# EasyEDA Pro project BLDCv5.eprj, schematic Schematic5
Board Name: Board3; Create Date: 2025-03-22; Page Name: P1; Project Name: BLDCv5; Schematic Name: Schematic5; Update Date: 2025-03-22; Company: EasyEDA.com; Drawn: EasyEDA; Page Size: A4; Part Number: JLCPCB-002; Reviewed: EasyEDA; Version: V0.1
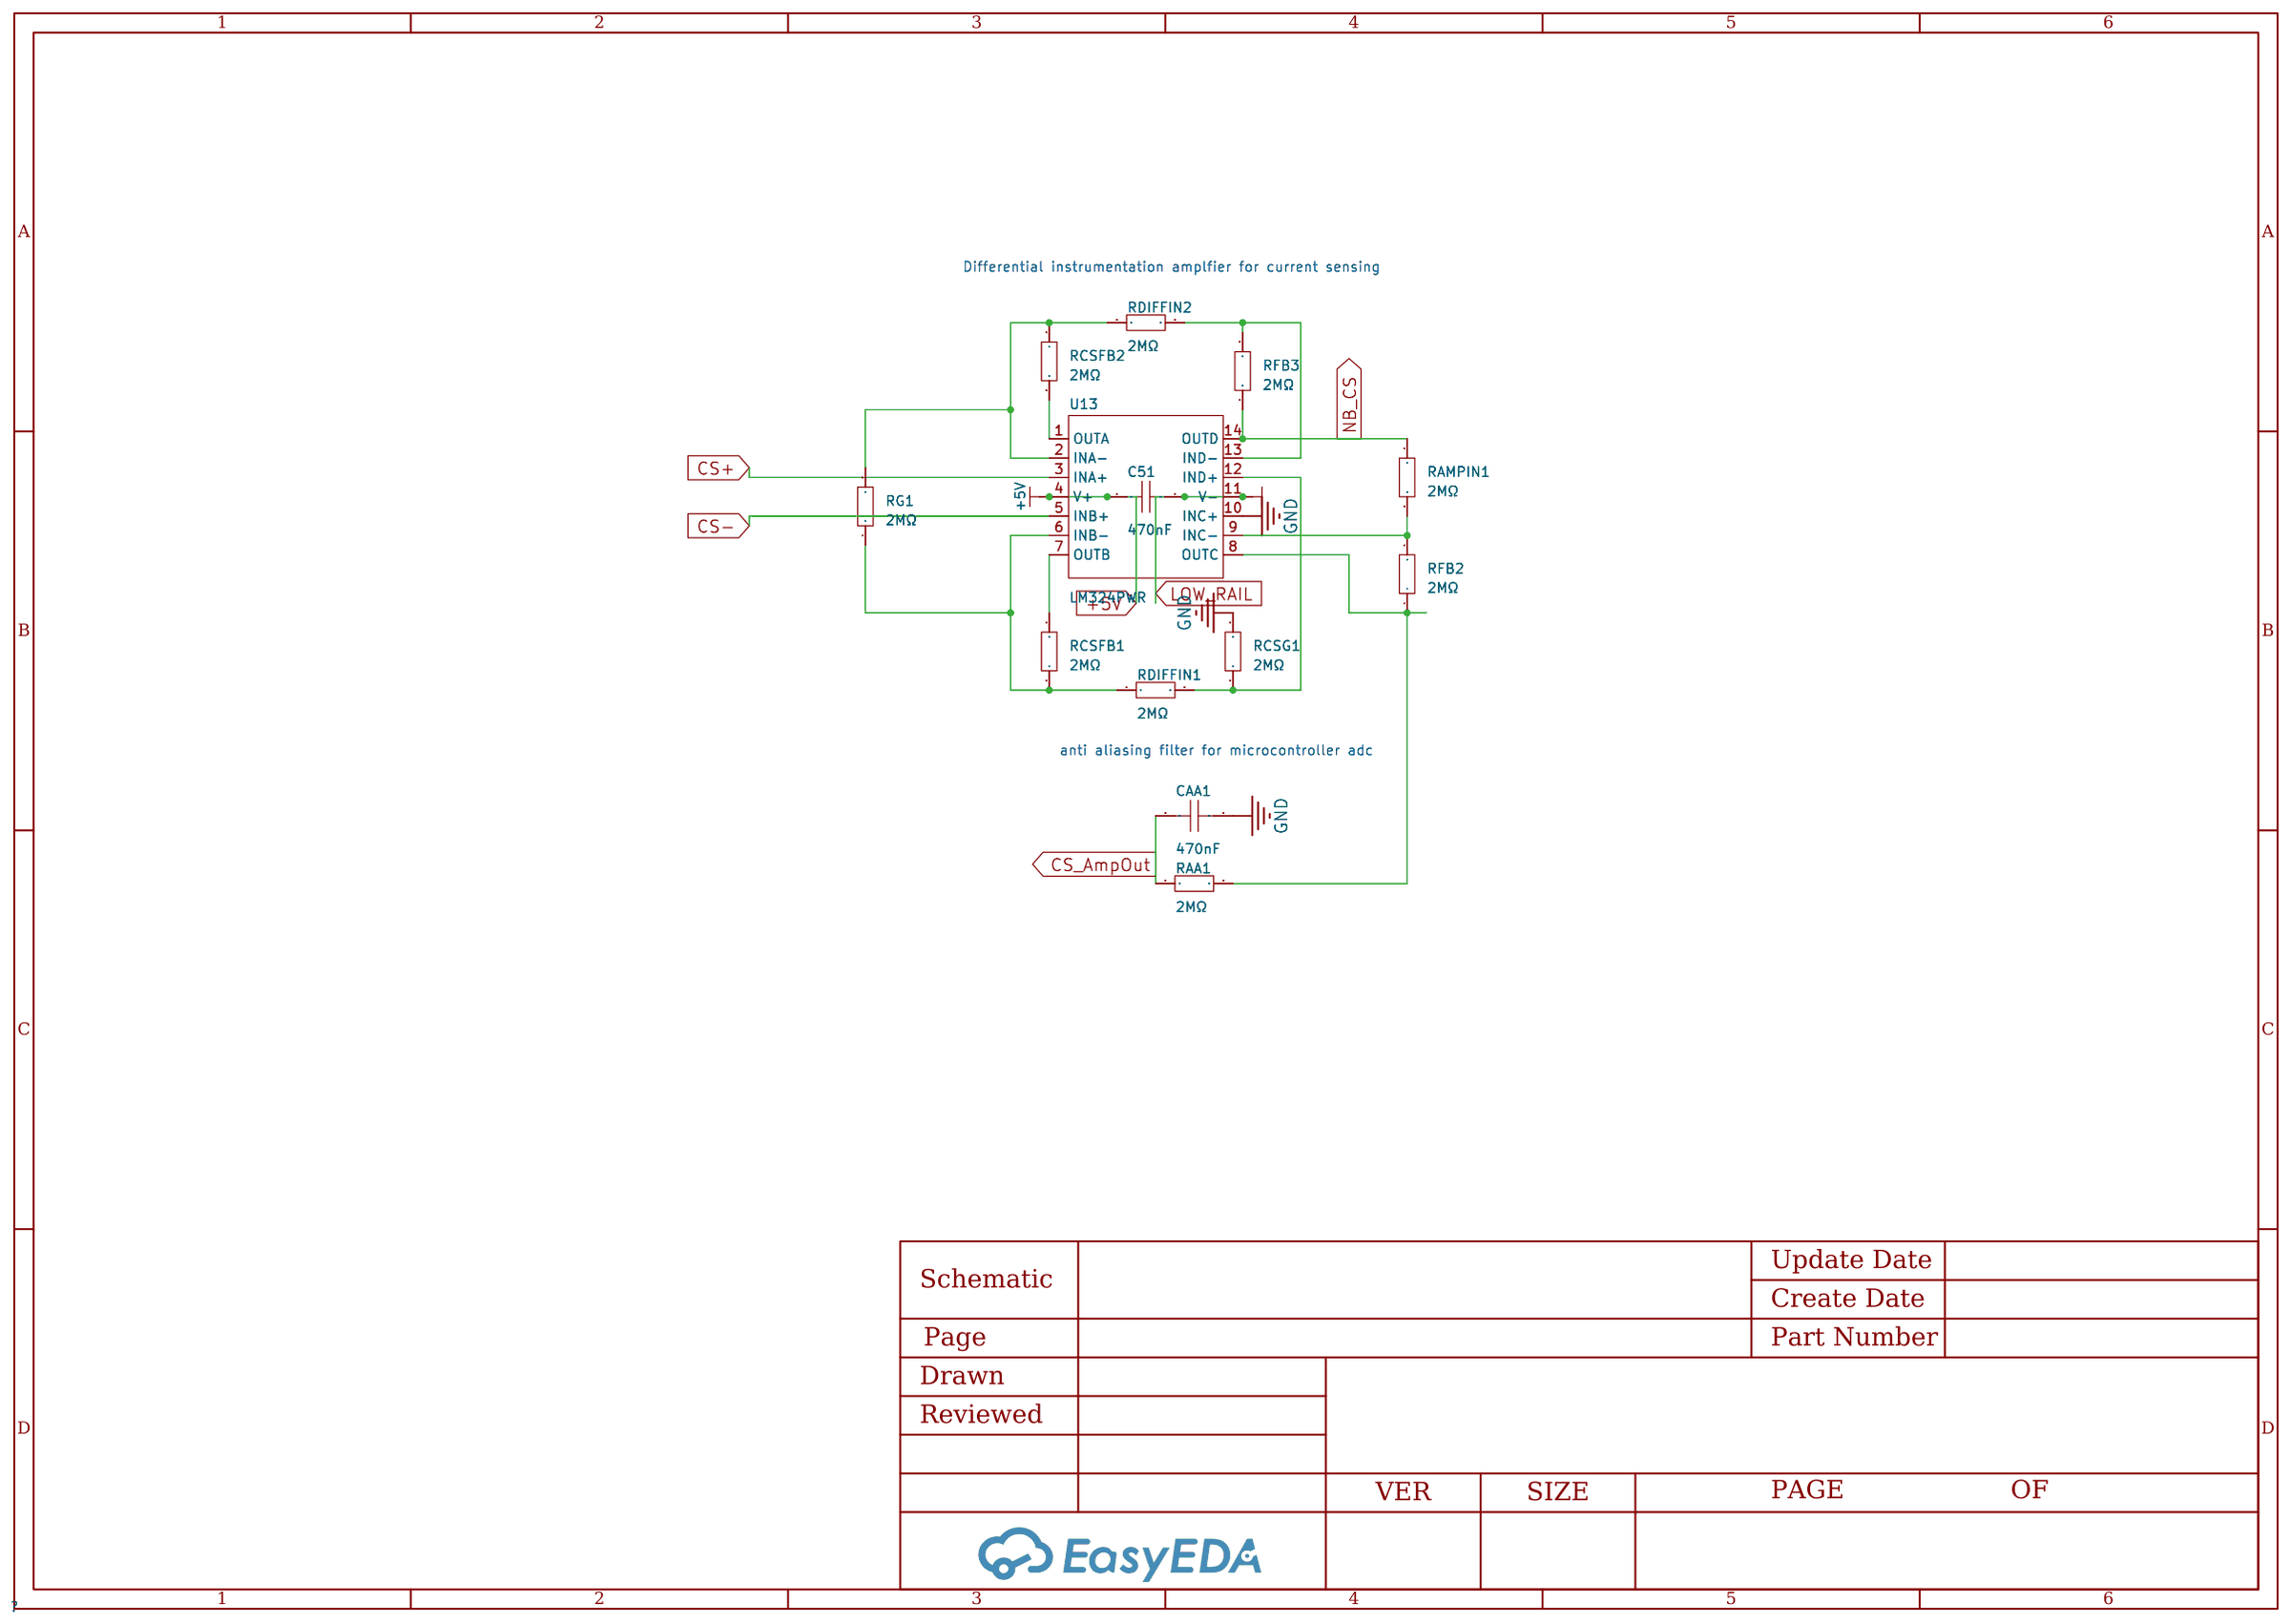
[diagram p6: schematic sheet]

## Parts
C51  470nF  [CAP-TH_L7.2-W2.5-P5.00-D0.5]
CAA1  470nF  [CAP-TH_L7.2-W2.5-P5.00-D0.5]
RAA1  2MΩ  [R0805]
RAMPIN1  2MΩ  [R0805]
RCSFB1  2MΩ  [R0805]
RCSFB2  2MΩ  [R0805]
RCSG1  2MΩ  [R0805]
RDIFFIN1  2MΩ  [R0805]
RDIFFIN2  2MΩ  [R0805]
RFB2  2MΩ  [R0805]
RFB3  2MΩ  [R0805]
RG1  2MΩ  [R0805]
U13  LM324PWR  [TSSOP-14_L5.0-W4.4-P0.65-LS6.4-BL]

## Library data of the parts
C51 CAA1 = C241J474J20C000: Capacitance:470nF Tolerance:±5% Tolerance:±5% Voltage Rated: Dielectric Material:Metallized Polyester Film Capacitor Operating Temperature:-55℃~+125℃ Operating Temperature:-55℃~+125℃; LCSC Part Name: 470nF ±5% 63V; Supplier Part: C5121927; Manufacturer: faratronic(厦门法拉); Supplier Footprint: 插件,P=5mm; JLCPCB Part Class: Extended Part; Datasheet: https://atta.szlcsc.com/upload/public/pdf/source/20220309/53E9D6585E584592026F1B9FCED89B93.pdf; Supplier: LCSC; Tolerance: ±5%; Dielectric Material: Metallized Polyester Film Capacitor; Operating Temperature: -55℃~+125℃
RAA1 RAMPIN1 RCSFB1 RCSFB2 RCSG1 RDIFFIN1 RDIFFIN2 RFB2 RFB3 RG1 = SCR0805J2M: Type:Thick Film Resistors Resistance:2MΩ Tolerance:±5% Tolerance:±5% Power(Watts): Overload Voltage (Max): Operating Temperature Range:-55℃~+155℃ Operating Temperature Range:-55℃~+155℃; LCSC Part Name: 厚膜电阻 2MΩ ±5% 125mW; Supplier Part: C3017921; Manufacturer: VO(翔胜); Supplier Footprint: 0805; JLCPCB Part Class: Extended Part; Datasheet: https://atta.szlcsc.com/upload/public/pdf/source/20220513/247AF9639BA21CF93567DC289CCC6A22.pdf; Supplier: LCSC; Type: Thick Film Resistors; Tolerance: ±5%; Operating Temperature Range: -55℃~+155℃
U13 = LM324PWR: Supplier Part: C7942; Manufacturer: TI(德州仪器); Supplier Footprint: TSSOP-14; JLCPCB Part Class: Extended Part; Datasheet: http://www.ti.com/cn/lit/gpn/lm324; Supplier: LCSC; Number of Circuits: Quad; Gain Bandwidth Product(GBP): 1.2MHz; Current - Input Bias(Ib): 20nA; Slew Rate(SR): 0.5V/us; Output Current: 30mA; Supply Current: 700uA; Operating Temperature: 0℃~+70℃

## Nets
+5V: C51.2 U13.4(V+)
GND: CAA1.1 RCSG1.2 U13.10(INC+)
CS+: U13.3(INA+)
CS-: U13.5(INB+)
CS_AmpOut: CAA1.2 RAA1.1
LOW_RAIL: C51.1 U13.11(V-)
NB_CS: RAMPIN1.1 RFB3.1 U13.14(OUTD)
$1N640: RAMPIN1.2 RFB2.2 U13.9(INC-)
$1N642: RDIFFIN2.2 RFB3.2 U13.13(IND-)
$1N644: RCSG1.1 RDIFFIN1.2 U13.12(IND+)
$1N647: RCSFB2.1 RDIFFIN2.1 RG1.2 U13.2(INA-)
$1N648: RCSFB1.2 RDIFFIN1.1 RG1.1 U13.6(INB-)
$1N649: RCSFB1.1 U13.7(OUTB)
$1N650: RCSFB2.2 U13.1(OUTA)
$1N669: RAA1.2 RFB2.1 U13.8(OUTC)

## Notes on the sheet
- Differential instrumentation amplfier for current sensing
- anti aliasing filter for microcontroller adc
